# EasyEDA Pro project wukong01-Y003-HTOL.eprj, board PCB1 (continued)
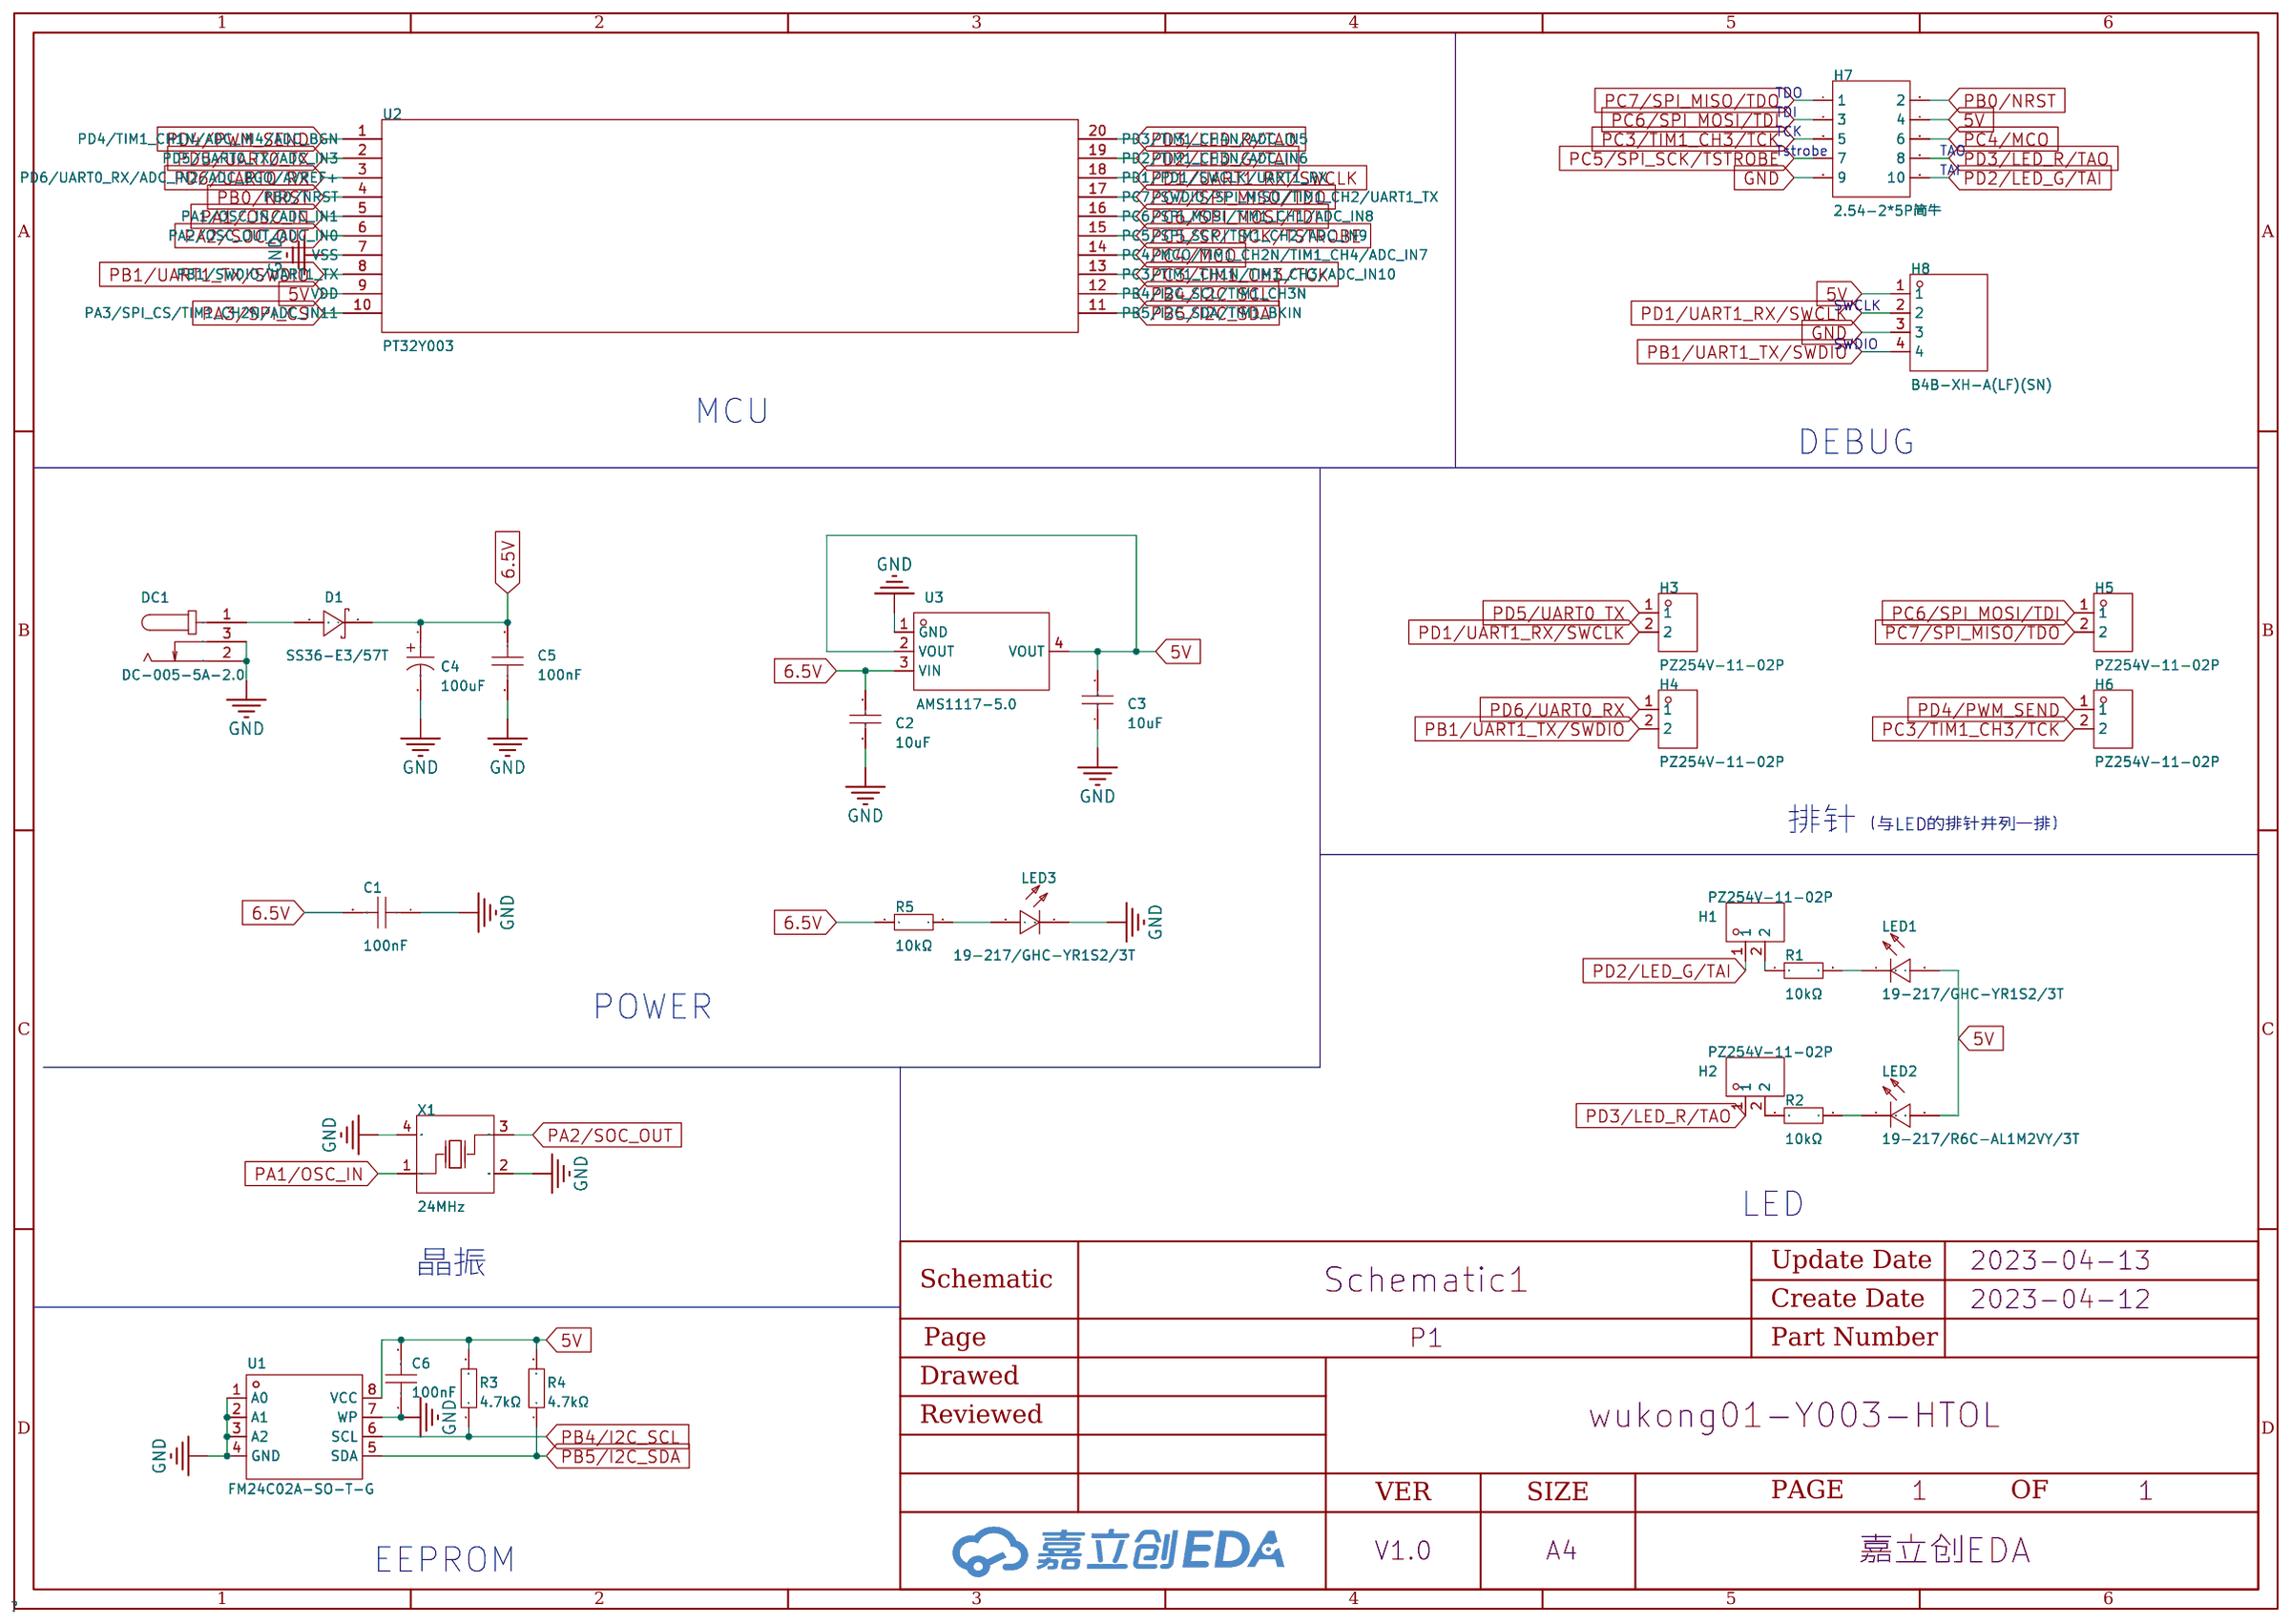
[diagram p0: schematic sheet]
## Routing (per net, layer and track width the routed paths; a pad name or vN(x,y) marks a point on that pad's centre or on a via; arc(x,y) is an arc through that point) (continued)
PC3/TIM1_CH3/TCK: length 2572.5
  Top Layer w0.254: v1(279.27,67.56) 274.83,67.56 H7#13.5 ; U2#27.13 81.76,230 v1(87.12,230) ; v1(136.14,144.15) 130.79,144.15 130.76,144.17 ; v1(132.21,67.56) 127.76,67.56 H7#17.5 ; H7#30.5 78.74,196.34 v1(83.19,196.34) ; v1(279.27,110.49) 274.83,110.49 274.83,113.67 ; v1(181.23,282.19) 176.78,282.19 H7#8.5 ; 176.78,27.81 176.78,24.64 v1(181.23,24.64) ; U2#19.13 228.83,58.29 v1(234.19,58.29) ; v1(38.1,187.07) 32.74,187.07 U2#35.13 ; v1(181.23,153.42) 176.78,153.42 176.78,156.59 ; v1(87.12,187.07) 81.76,187.07 U2#33.13 ; U2#14.13 81.76,58.29 v1(87.12,58.29) ; v1(279.27,153.42) 274.83,153.42 274.83,156.59 ; v1(279.27,239.27) 274.83,239.27 H7#26.5 ; H7#22.5 225.81,67.56 v1(230.25,67.56) ; v1(34.16,67.56) 29.72,67.56 H7#12.5 ; v1(132.21,110.49) 127.76,110.49 127.76,113.67 ; U2#9.13 81.76,272.92 v1(87.12,272.92) ; v1(185.17,58.29) 179.81,58.29 U2#7.13 ; H7#28.5 29.72,239.27 v1(34.16,239.27) ; v1(230.25,239.27) 225.81,239.27 H7#27.5 ; H7#31.5 176.78,196.34 v1(181.23,196.34) ; 130.76,230.02 130.79,230 v1(136.14,230) ; v1(234.19,272.92) 228.83,272.92 U2#16.13 ; U2#37.13 277.85,144.15 v1(283.21,144.15) ; U2#12.13 277.85,58.29 v1(283.21,58.29) ; v1(283.21,187.07) 277.85,187.07 U2#31.13 ; v1(230.25,153.42) 225.81,153.42 225.81,156.59 ; 29.72,113.67 29.72,110.49 v1(34.16,110.49) ; v1(279.27,282.19) 274.83,282.19 H7#10.5 ; H7#33.5 225.81,196.34 v1(230.25,196.34) ; U2#20.13 32.74,58.29 v1(38.1,58.29) ; 29.72,27.81 29.72,24.64 v1(34.16,24.64) ; U2#23.13 81.76,15.37 v1(87.12,15.37) ; H7#16.5 176.78,67.56 v1(181.23,67.56) ; v1(132.21,196.34) 127.76,196.34 H7#29.5 ; U2#38.13 228.83,144.15 v1(234.19,144.15) ; v1(185.17,272.92) 179.81,272.92 U2#10.13 ; v1(234.19,15.37) 228.83,15.37 U2#21.13 ; v1(181.23,239.27) 176.78,239.27 H7#25.5 ; v1(234.19,187.07) 228.83,187.07 U2#32.13 ; v1(185.17,101.22) 179.81,101.22 U2#6.13 ; v1(283.21,101.22) 277.85,101.22 U2#3.13 ; v1(230.25,110.49) 225.81,110.49 225.81,113.67 ; 130.76,272.95 130.79,272.92 v1(136.14,272.92) ; v1(283.21,230) 277.85,230 U2#25.13 ; v1(136.14,187.07) 130.79,187.07 130.76,187.1 ; U2#17.13 179.81,15.37 v1(185.17,15.37) ; v1(283.21,272.92) 277.85,272.92 U2#13.13 ; v1(132.21,24.64) 127.76,24.64 127.76,27.81 ; v1(136.14,58.29) 130.79,58.29 130.76,58.32 ; v1(83.19,24.64) 78.74,24.64 78.74,27.81 ; H7#32.5 274.83,196.34 v1(279.27,196.34) ; v1(136.14,101.22) 130.79,101.22 130.76,101.25 ; U2#34.13 179.81,187.07 v1(185.17,187.07) ; 176.78,113.67 176.78,110.49 v1(181.23,110.49) ; U2#4.13 228.83,101.22 v1(234.19,101.22) ; v1(38.1,230) 32.74,230 U2#29.13 ; 78.74,113.67 78.74,110.49 v1(83.19,110.49) ; H7#15.5 78.74,67.56 v1(83.19,67.56) ; H7#34.5 29.72,196.34 v1(34.16,196.34) ; U2#8.13 32.74,101.22 v1(38.1,101.22) ; v1(230.25,282.19) 225.81,282.19 H7#14.5 ; 127.76,156.59 127.76,153.42 v1(132.21,153.42) ; v1(136.14,15.37) 130.79,15.37 130.76,15.39 ; v1(87.12,144.15) 81.76,144.15 U2#39.13 ; v1(38.1,15.37) 32.74,15.37 U2#22.13 ; v1(83.19,153.42) 78.74,153.42 78.74,156.59 ; v1(132.21,282.19) 127.76,282.19 H7#9.5 ; 225.81,27.81 225.81,24.64 v1(230.25,24.64) ; v1(83.19,239.27) 78.74,239.27 H7#24.5 ; v1(38.1,144.15) 32.74,144.15 U2.13 ; H7#7.5 78.74,282.19 v1(83.19,282.19) ; U2#28.13 179.81,230 v1(185.17,230) ; v1(132.21,239.27) 127.76,239.27 H7#23.5 ; U2#26.13 228.83,230 v1(234.19,230) ; U2#40.13 179.81,144.15 v1(185.17,144.15) ; v1(87.12,101.22) 81.76,101.22 U2#5.13 ; v1(34.16,153.42) 29.72,153.42 29.72,156.59
  Bottom Layer w0.254: 238,145.29 238,152.65 237.24,153.42 v1(230.25,153.42) ; 238,145.29 238,137.67 239.01,136.65 246.89,136.65 247.78,137.54 247.78,146.56 247.01,147.32 H6#40.2 ; 238,145.29 235.69,145.29 234.55,144.15 v1(234.19,144.15) ; v1(283.21,230) 283.57,230 284.71,231.14 287.02,231.14 ; H6#27.2 50.93,233.17 51.69,232.41 51.69,223.39 50.8,222.5 42.93,222.5 41.91,223.52 41.91,231.14 ; 238,231.14 238,238.51 237.24,239.27 v1(230.25,239.27) ; 238,231.14 238,223.52 239.01,222.5 246.89,222.5 247.78,223.39 247.78,232.41 247.01,233.17 H6#28.2 ; 238,231.14 235.69,231.14 234.55,230 v1(234.19,230) ; 41.91,145.29 41.91,137.67 42.93,136.65 50.8,136.65 51.69,137.54 51.69,146.56 50.93,147.32 H6#39.2 ; 41.91,145.29 41.91,152.65 41.15,153.42 v1(34.16,153.42) ; 41.91,145.29 39.6,145.29 38.46,144.15 v1(38.1,144.15) ; 188.98,145.29 188.98,137.67 189.99,136.65 197.87,136.65 198.75,137.54 198.75,146.56 197.99,147.32 H6#36.2 ; 188.98,145.29 188.98,152.65 188.21,153.42 v1(181.23,153.42) ; 188.98,145.29 186.67,145.29 185.53,144.15 v1(185.17,144.15) ; 188.98,231.14 188.98,238.51 188.21,239.27 v1(181.23,239.27) ; 188.98,231.14 188.98,223.52 189.99,222.5 197.87,222.5 198.75,223.39 198.75,232.41 197.99,233.17 H6#24.2 ; 188.98,231.14 186.67,231.14 185.53,230 v1(185.17,230) ; v1(132.21,110.49) 139.19,110.49 139.95,109.73 139.95,102.36 ; 287.02,231.14 287.02,223.52 288.04,222.5 295.91,222.5 296.8,223.39 296.8,232.41 296.04,233.17 H6#29.2 ; 287.02,231.14 287.02,238.51 286.26,239.27 v1(279.27,239.27) ; 139.95,16.51 139.95,23.88 139.19,24.64 v1(132.21,24.64) ; 139.95,16.51 137.65,16.51 136.5,15.37 v1(136.14,15.37) ; 139.95,16.51 139.95,8.89 140.97,7.87 148.84,7.87 149.73,8.76 149.73,17.78 148.97,18.54 H6#19.2 ; 41.91,102.36 39.6,102.36 38.46,101.22 v1(38.1,101.22) ; 41.91,102.36 41.91,109.73 41.15,110.49 v1(34.16,110.49) ; 41.91,102.36 41.91,94.74 42.93,93.73 50.8,93.73 51.69,94.62 51.69,103.63 50.93,104.39 H6#5.2 ; H6#9.2 197.99,276.1 198.75,275.34 198.75,266.32 197.87,265.43 189.99,265.43 188.98,266.45 188.98,274.07 ; 238,274.07 238,266.45 239.01,265.43 246.89,265.43 247.78,266.32 247.78,275.34 247.01,276.1 H6#12.2 ; 238,274.07 238,281.43 237.24,282.19 v1(230.25,282.19) ; 238,274.07 235.69,274.07 234.55,272.92 v1(234.19,272.92) ; v1(87.12,15.37) 87.48,15.37 88.62,16.51 90.93,16.51 ; 287.02,145.29 287.02,152.65 286.26,153.42 v1(279.27,153.42) ; 287.02,145.29 284.71,145.29 283.57,144.15 v1(283.21,144.15) ; 287.02,145.29 287.02,137.67 288.04,136.65 295.91,136.65 296.8,137.54 296.8,146.56 296.04,147.32 H6.2 ; H6#8.2 99.95,276.1 100.71,275.34 100.71,266.32 99.82,265.43 91.95,265.43 90.93,266.45 90.93,274.07 ; 139.95,102.36 137.65,102.36 136.5,101.22 v1(136.14,101.22) ; 139.95,102.36 139.95,94.74 140.97,93.73 148.84,93.73 149.73,94.62 149.73,103.63 148.97,104.39 H6#3.2 ; v1(132.21,67.56) 139.19,67.56 139.95,66.8 139.95,59.44 ; H6#2.2 197.99,104.39 198.75,103.63 198.75,94.62 197.87,93.73 189.99,93.73 188.98,94.74 188.98,102.36 ; H6#38.2 99.95,147.32 100.71,146.56 100.71,137.54 99.82,136.65 91.95,136.65 90.93,137.67 90.93,145.29 ; v1(230.25,110.49) 237.24,110.49 238,109.73 238,102.36 ; v1(83.19,239.27) 90.17,239.27 90.93,238.51 90.93,231.14 ; v1(34.16,24.64) 41.15,24.64 41.91,23.88 41.91,16.51 ; H6#22.2 296.04,61.47 296.8,60.71 296.8,51.69 295.91,50.8 288.04,50.8 287.02,51.82 287.02,59.44 ; 139.95,231.14 139.95,238.51 139.19,239.27 v1(132.21,239.27) ; 139.95,231.14 139.95,223.52 140.97,222.5 148.84,222.5 149.73,223.39 149.73,232.41 148.97,233.17 H6#25.2 ; 139.95,231.14 137.65,231.14 136.5,230 v1(136.14,230) ; v1(132.21,196.34) 139.19,196.34 139.95,195.58 139.95,188.21 ; 41.91,231.14 39.6,231.14 38.46,230 v1(38.1,230) ; 41.91,231.14 41.91,238.51 41.15,239.27 v1(34.16,239.27) ; 188.98,102.36 186.67,102.36 185.53,101.22 v1(185.17,101.22) ; 188.98,102.36 188.98,109.73 188.21,110.49 v1(181.23,110.49) ; 287.02,274.07 287.02,281.43 286.26,282.19 v1(279.27,282.19) ; 287.02,274.07 287.02,266.45 288.04,265.43 295.91,265.43 296.8,266.32 296.8,275.34 296.04,276.1 H6#11.2 ; 287.02,274.07 284.71,274.07 283.57,272.92 v1(283.21,272.92) ; v1(136.14,272.92) 136.5,272.92 137.65,274.07 139.95,274.07 ; 41.91,59.44 41.91,66.8 41.15,67.56 v1(34.16,67.56) ; 41.91,59.44 41.91,51.82 42.93,50.8 50.8,50.8 51.69,51.69 51.69,60.71 50.93,61.47 H6#13.2 ; 41.91,59.44 39.6,59.44 38.46,58.29 v1(38.1,58.29) ; 287.02,102.36 284.71,102.36 283.57,101.22 v1(283.21,101.22) ; 287.02,102.36 287.02,109.73 286.26,110.49 v1(279.27,110.49) ; 287.02,102.36 287.02,94.74 288.04,93.73 295.91,93.73 296.8,94.62 296.8,103.63 296.04,104.39 H6#7.2 ; 188.98,274.07 188.98,281.43 188.21,282.19 v1(181.23,282.19) ; 188.98,274.07 186.67,274.07 185.53,272.92 v1(185.17,272.92) ; v1(132.21,153.42) 139.19,153.42 139.95,152.65 139.95,145.29 ; v1(230.25,24.64) 237.24,24.64 238,23.88 238,16.51 ; v1(87.12,230) 87.48,230 88.62,231.14 90.93,231.14 ; v1(185.17,58.29) 185.53,58.29 186.67,59.44 188.98,59.44 ; H6#17.2 50.93,18.54 51.69,17.78 51.69,8.76 50.8,7.87 42.93,7.87 41.91,8.89 41.91,16.51 ; 139.95,145.29 139.95,137.67 140.97,136.65 148.84,136.65 149.73,137.54 149.73,146.56 148.97,147.32 H6#37.2 ; 139.95,145.29 137.65,145.29 136.5,144.15 v1(136.14,144.15) ; 238,59.44 238,66.8 237.24,67.56 v1(230.25,67.56) ; 238,59.44 235.69,59.44 234.55,58.29 v1(234.19,58.29) ; 238,59.44 238,51.82 239.01,50.8 246.89,50.8 247.78,51.69 247.78,60.71 247.01,61.47 H6#20.2 ; 287.02,188.21 287.02,195.58 286.26,196.34 v1(279.27,196.34) ; 287.02,188.21 284.71,188.21 283.57,187.07 v1(283.21,187.07) ; 287.02,188.21 287.02,180.59 288.04,179.58 295.91,179.58 296.8,180.47 296.8,189.48 296.04,190.25 H6#35.2 ; H6#23.2 99.95,18.54 100.71,17.78 100.71,8.76 99.82,7.87 91.95,7.87 90.93,8.89 90.93,16.51 ; 139.95,274.07 139.95,281.43 139.19,282.19 v1(132.21,282.19) ; 139.95,274.07 139.95,266.45 140.97,265.43 148.84,265.43 149.73,266.32 149.73,275.34 148.97,276.1 H6#10.2 ; v1(136.14,187.07) 136.5,187.07 137.65,188.21 139.95,188.21 ; 238,102.36 235.69,102.36 234.55,101.22 v1(234.19,101.22) ; 238,102.36 238,94.74 239.01,93.73 246.89,93.73 247.78,94.62 247.78,103.63 247.01,104.39 H6#6.2 ; v1(87.12,187.07) 87.48,187.07 88.62,188.21 90.93,188.21 ; 139.95,59.44 137.65,59.44 136.5,58.29 v1(136.14,58.29) ; 139.95,59.44 139.95,51.82 140.97,50.8 148.84,50.8 149.73,51.69 149.73,60.71 148.97,61.47 H6#14.2 ; 90.93,102.36 90.93,94.74 91.95,93.73 99.82,93.73 100.71,94.62 100.71,103.63 99.95,104.39 H6#4.2 ; 90.93,102.36 88.62,102.36 87.48,101.22 v1(87.12,101.22) ; 90.93,102.36 90.93,109.73 90.17,110.49 v1(83.19,110.49) ; 90.93,145.29 88.62,145.29 87.48,144.15 v1(87.12,144.15) ; 90.93,145.29 90.93,152.65 90.17,153.42 v1(83.19,153.42) ; 90.93,16.51 90.93,23.88 90.17,24.64 v1(83.19,24.64) ; 188.98,59.44 188.98,51.82 189.99,50.8 197.87,50.8 198.75,51.69 198.75,60.71 197.99,61.47 H6#15.2 ; 188.98,59.44 188.98,66.8 188.21,67.56 v1(181.23,67.56) ; 238,188.21 235.69,188.21 234.55,187.07 v1(234.19,187.07) ; 238,188.21 238,180.59 239.01,179.58 246.89,179.58 247.78,180.47 247.78,189.48 247.01,190.25 H6#34.2 ; 238,188.21 238,195.58 237.24,196.34 v1(230.25,196.34) ; H6#30.2 197.99,190.25 198.75,189.48 198.75,180.47 197.87,179.58 189.99,179.58 188.98,180.59 188.98,188.21 ; 188.98,188.21 186.67,188.21 185.53,187.07 v1(185.17,187.07) ; 188.98,188.21 188.98,195.58 188.21,196.34 v1(181.23,196.34) ; 90.93,231.14 90.93,223.52 91.95,222.5 99.82,222.5 100.71,223.39 100.71,232.41 99.95,233.17 H6#26.2 ; 188.98,16.51 188.98,8.89 189.99,7.87 197.87,7.87 198.75,8.76 198.75,17.78 197.99,18.54 H6#16.2 ; 188.98,16.51 188.98,23.88 188.21,24.64 v1(181.23,24.64) ; 188.98,16.51 186.67,16.51 185.53,15.37 v1(185.17,15.37) ; 238,16.51 238,8.89 239.01,7.87 246.89,7.87 247.78,8.76 247.78,17.78 247.01,18.54 H6#21.2 ; 238,16.51 235.69,16.51 234.55,15.37 v1(234.19,15.37) ; 90.93,59.44 90.93,66.8 90.17,67.56 v1(83.19,67.56) ; 90.93,59.44 90.93,51.82 91.95,50.8 99.82,50.8 100.71,51.69 100.71,60.71 99.95,61.47 H6#18.2 ; 90.93,59.44 88.62,59.44 87.48,58.29 v1(87.12,58.29) ; 41.91,188.21 41.91,180.59 42.93,179.58 50.8,179.58 51.69,180.47 51.69,189.48 50.93,190.25 H6#33.2 ; 41.91,188.21 41.91,195.58 41.15,196.34 v1(34.16,196.34) ; 41.91,188.21 39.6,188.21 38.46,187.07 v1(38.1,187.07) ; v1(83.19,282.19) 90.17,282.19 90.93,281.43 90.93,274.07 ; 139.95,188.21 139.95,180.59 140.97,179.58 148.84,179.58 149.73,180.47 149.73,189.48 148.97,190.25 H6#31.2 ; v1(283.21,58.29) 283.57,58.29 284.71,59.44 287.02,59.44 ; 287.02,59.44 287.02,66.8 286.26,67.56 v1(279.27,67.56) ; v1(87.12,272.92) 87.48,272.92 88.62,274.07 90.93,274.07 ; 90.93,188.21 90.93,180.59 91.95,179.58 99.82,179.58 100.71,180.47 100.71,189.48 99.95,190.25 H6#32.2 ; 90.93,188.21 90.93,195.58 90.17,196.34 v1(83.19,196.34) ; 41.91,16.51 39.6,16.51 38.46,15.37 v1(38.1,15.37)
PC4/MCO: length 1115.8
  Top Layer w0.254: H7#40.6 29.72,158.12 30.1,157.73 37.72,157.73 38.48,156.97 v1(38.48,151.89) ; v1(136.53,151.89) 136.53,156.97 135.76,157.73 128.14,157.73 127.76,158.12 H7#35.6 ; v1(234.19,144.91) 234.1,144.82 U2#38.14 ; U2#34.14 185.08,187.75 v1(185.17,187.83) ; U2#13.14 283.12,273.6 v1(283.21,273.69) ; v1(185.55,23.11) 185.55,28.19 184.78,28.96 177.16,28.96 176.78,29.34 H7#21.6 ; U2#9.14 87.04,273.6 v1(87.12,273.69) ; v1(234.19,16.13) 234.1,16.04 U2#21.14 ; v1(136.14,230.76) 136.06,230.67 130.76,230.67 ; v1(283.21,187.83) 283.12,187.75 U2#31.14 ; v1(87.12,16.13) 87.04,16.04 U2#23.14 ; 130.76,273.6 136.06,273.6 v1(136.14,273.69) ; v1(87.12,59.06) 87.04,58.97 U2#14.14 ; H7#19.6 78.74,29.34 79.12,28.96 86.74,28.96 87.5,28.19 v1(87.5,23.11) ; v1(283.59,194.82) 283.59,199.9 282.83,200.66 275.21,200.66 274.83,201.04 H7#32.6 ; H7#25.6 176.78,243.97 177.16,243.59 184.78,243.59 185.55,242.82 v1(185.55,237.74) ; v1(136.53,237.74) 136.53,242.82 135.76,243.59 128.14,243.59 127.76,243.97 H7#23.6 ; v1(234.19,187.83) 234.1,187.75 U2#32.14 ; U2#26.14 234.1,230.67 v1(234.19,230.76) ; H7#2.6 78.74,115.19 79.12,114.81 86.74,114.81 87.5,114.05 v1(87.5,108.97) ; v1(283.59,66.04) 283.59,71.12 282.83,71.88 275.21,71.88 274.83,72.26 H7#13.6 ; H7#3.6 176.78,115.19 177.16,114.81 184.78,114.81 185.55,114.05 v1(185.55,108.97) ; v1(185.55,66.04) 185.55,71.12 184.78,71.88 177.16,71.88 176.78,72.26 H7#16.6 ; H7#30.6 78.74,201.04 79.12,200.66 86.74,200.66 87.5,199.9 v1(87.5,194.82) ; v1(185.55,280.67) 185.55,285.75 184.78,286.51 177.16,286.51 176.78,286.89 H7#8.6 ; v1(136.53,280.67) 136.53,285.75 135.76,286.51 128.14,286.51 127.76,286.89 H7#9.6 ; 130.76,187.75 136.06,187.75 v1(136.14,187.83) ; v1(283.21,144.91) 283.12,144.82 U2#37.14 ; H7#28.6 29.72,243.97 30.1,243.59 37.72,243.59 38.48,242.82 v1(38.48,237.74) ; v1(87.12,101.98) 87.04,101.9 U2#5.14 ; U2.14 38.01,144.82 v1(38.1,144.91) ; H7#33.6 225.81,201.04 226.19,200.66 233.81,200.66 234.57,199.9 v1(234.57,194.82) ; v1(234.19,59.06) 234.1,58.97 U2#19.14 ; v1(136.14,59.06) 136.06,58.97 130.76,58.97 ; v1(185.17,273.69) 185.08,273.6 U2#10.14 ; v1(38.48,194.82) 38.48,199.9 37.72,200.66 30.1,200.66 29.72,201.04 H7#34.6 ; v1(185.17,16.13) 185.08,16.04 U2#17.14 ; v1(38.1,101.98) 38.01,101.9 U2#8.14 ; v1(234.19,101.98) 234.1,101.9 U2#4.14 ; H7#10.6 274.83,286.89 275.21,286.51 282.83,286.51 283.59,285.75 v1(283.59,280.67) ; U2#29.14 38.01,230.67 v1(38.1,230.76) ; v1(136.14,16.13) 136.06,16.04 130.76,16.04 ; v1(38.48,108.97) 38.48,114.05 37.72,114.81 30.1,114.81 29.72,115.19 H7#6.6 ; 130.76,101.9 136.06,101.9 v1(136.14,101.98) ; v1(87.5,66.04) 87.5,71.12 86.74,71.88 79.12,71.88 78.74,72.26 H7#15.6 ; v1(283.21,101.98) 283.12,101.9 U2#3.14 ; H7#24.6 78.74,243.97 79.12,243.59 86.74,243.59 87.5,242.82 v1(87.5,237.74) ; v1(185.17,101.98) 185.08,101.9 U2#6.14 ; H7#29.6 127.76,201.04 128.14,200.66 135.76,200.66 136.53,199.9 v1(136.53,194.82) ; U2#28.14 185.08,230.67 v1(185.17,230.76) ; U2#39.14 87.04,144.82 v1(87.12,144.91) ; v1(234.57,151.89) 234.57,156.97 233.81,157.73 226.19,157.73 225.81,158.12 H7#39.6 ; v1(38.1,59.06) 38.01,58.97 U2#20.14 ; v1(38.48,66.04) 38.48,71.12 37.72,71.88 30.1,71.88 29.72,72.26 H7#12.6 ; v1(234.57,108.97) 234.57,114.05 233.81,114.81 226.19,114.81 225.81,115.19 H7#5.6 ; v1(283.21,59.06) 283.12,58.97 U2#12.14 ; H7#20.6 127.76,29.34 128.14,28.96 135.76,28.96 136.53,28.19 v1(136.53,23.11) ; v1(234.57,66.04) 234.57,71.12 233.81,71.88 226.19,71.88 225.81,72.26 H7#22.6 ; v1(283.59,151.89) 283.59,156.97 282.83,157.73 275.21,157.73 274.83,158.12 H7#38.6 ; v1(38.1,187.83) 38.01,187.75 U2#35.14 ; H7#7.6 78.74,286.89 79.12,286.51 86.74,286.51 87.5,285.75 v1(87.5,280.67) ; H7#31.6 176.78,201.04 177.16,200.66 184.78,200.66 185.55,199.9 v1(185.55,194.82) ; H7#4.6 274.83,115.19 275.21,114.81 282.83,114.81 283.59,114.05 v1(283.59,108.97) ; v1(283.59,237.74) 283.59,242.82 282.83,243.59 275.21,243.59 274.83,243.97 H7#26.6 ; v1(185.17,144.91) 185.08,144.82 U2#40.14 ; v1(136.53,108.97) 136.53,114.05 135.76,114.81 128.14,114.81 127.76,115.19 H7.6 ; H7#27.6 225.81,243.97 226.19,243.59 233.81,243.59 234.57,242.82 v1(234.57,237.74) ; U2#25.14 283.12,230.67 v1(283.21,230.76) ; U2#22.14 38.01,16.04 v1(38.1,16.13) ; H7#36.6 78.74,158.12 79.12,157.73 86.74,157.73 87.5,156.97 v1(87.5,151.89) ; U2#7.14 185.08,58.97 v1(185.17,59.06) ; v1(185.55,151.89) 185.55,156.97 184.78,157.73 177.16,157.73 176.78,158.12 H7#37.6 ; v1(38.48,23.11) 38.48,28.19 37.72,28.96 30.1,28.96 29.72,29.34 H7#11.6 ; v1(234.19,273.69) 234.1,273.6 U2#16.14 ; H7#17.6 127.76,72.26 128.14,71.88 135.76,71.88 136.53,71.12 v1(136.53,66.04) ; 130.76,144.82 136.06,144.82 v1(136.14,144.91) ; H7#18.6 225.81,29.34 226.19,28.96 233.81,28.96 234.57,28.19 v1(234.57,23.11) ; v1(87.12,230.76) 87.04,230.67 U2#27.14 ; v1(234.57,280.67) 234.57,285.75 233.81,286.51 226.19,286.51 225.81,286.89 H7#14.6 ; v1(87.12,187.83) 87.04,187.75 U2#33.14
  Bottom Layer w0.254: v1(38.1,230.76) 38.48,231.14 v1(38.48,237.74) ; v1(234.57,194.82) 234.57,188.21 v1(234.19,187.83) ; v1(38.48,66.04) 38.48,59.44 v1(38.1,59.06) ; v1(234.57,151.89) 234.57,145.29 v1(234.19,144.91) ; v1(185.17,16.13) 185.55,16.51 v1(185.55,23.11) ; v1(38.48,194.82) 38.48,188.21 v1(38.1,187.83) ; v1(136.53,23.11) 136.53,16.51 v1(136.14,16.13) ; v1(87.12,59.06) 87.5,59.44 v1(87.5,66.04) ; v1(38.48,108.97) 38.48,102.36 v1(38.1,101.98) ; v1(87.12,144.91) 87.5,145.29 v1(87.5,151.89) ; v1(234.19,273.69) 234.57,274.07 v1(234.57,280.67) ; v1(38.1,16.13) 38.48,16.51 v1(38.48,23.11) ; v1(185.55,151.89) 185.55,145.29 v1(185.17,144.91) ; v1(87.12,230.76) 87.5,231.14 v1(87.5,237.74) ; v1(283.21,187.83) 283.59,188.21 v1(283.59,194.82) ; v1(234.19,101.98) 234.57,102.36 v1(234.57,108.97) ; v1(87.12,187.83) 87.5,188.21 v1(87.5,194.82) ; v1(185.55,108.97) 185.55,102.36 v1(185.17,101.98) ; v1(136.53,237.74) 136.53,231.14 v1(136.14,230.76) ; v1(136.53,66.04) 136.53,59.44 v1(136.14,59.06) ; v1(185.17,59.06) 185.55,59.44 v1(185.55,66.04) ; v1(136.53,194.82) 136.53,188.21 v1(136.14,187.83) ; v1(234.19,16.13) 234.57,16.51 v1(234.57,23.11) ; v1(87.12,273.69) 87.5,274.07 v1(87.5,280.67) ; v1(38.1,144.91) 38.48,145.29 v1(38.48,151.89) ; v1(283.21,59.06) 283.59,59.44 v1(283.59,66.04) ; v1(185.55,194.82) 185.55,188.21 v1(185.17,187.83) ; v1(136.14,144.91) 136.53,145.29 v1(136.53,151.89) ; v1(136.14,101.98) 136.53,102.36 v1(136.53,108.97) ; v1(234.57,66.04) 234.57,59.44 v1(234.19,59.06) ; v1(87.5,108.97) 87.5,102.36 v1(87.12,101.98) ; v1(87.5,23.11) 87.5,16.51 v1(87.12,16.13) ; v1(234.57,237.74) 234.57,231.14 v1(234.19,230.76) ; v1(283.21,144.91) 283.59,145.29 v1(283.59,151.89) ; v1(185.17,273.69) 185.55,274.07 v1(185.55,280.67) ; v1(283.21,101.98) 283.59,102.36 v1(283.59,108.97) ; v1(283.21,230.76) 283.59,231.14 v1(283.59,237.74) ; v1(283.21,273.69) 283.59,274.07 v1(283.59,280.67) ; v1(136.14,273.69) 136.53,274.07 v1(136.53,280.67) ; v1(185.17,230.76) 185.55,231.14 v1(185.55,237.74)
